# EasyEDA Pro project MyWordEdit.eprj, board PCB1 (continued)
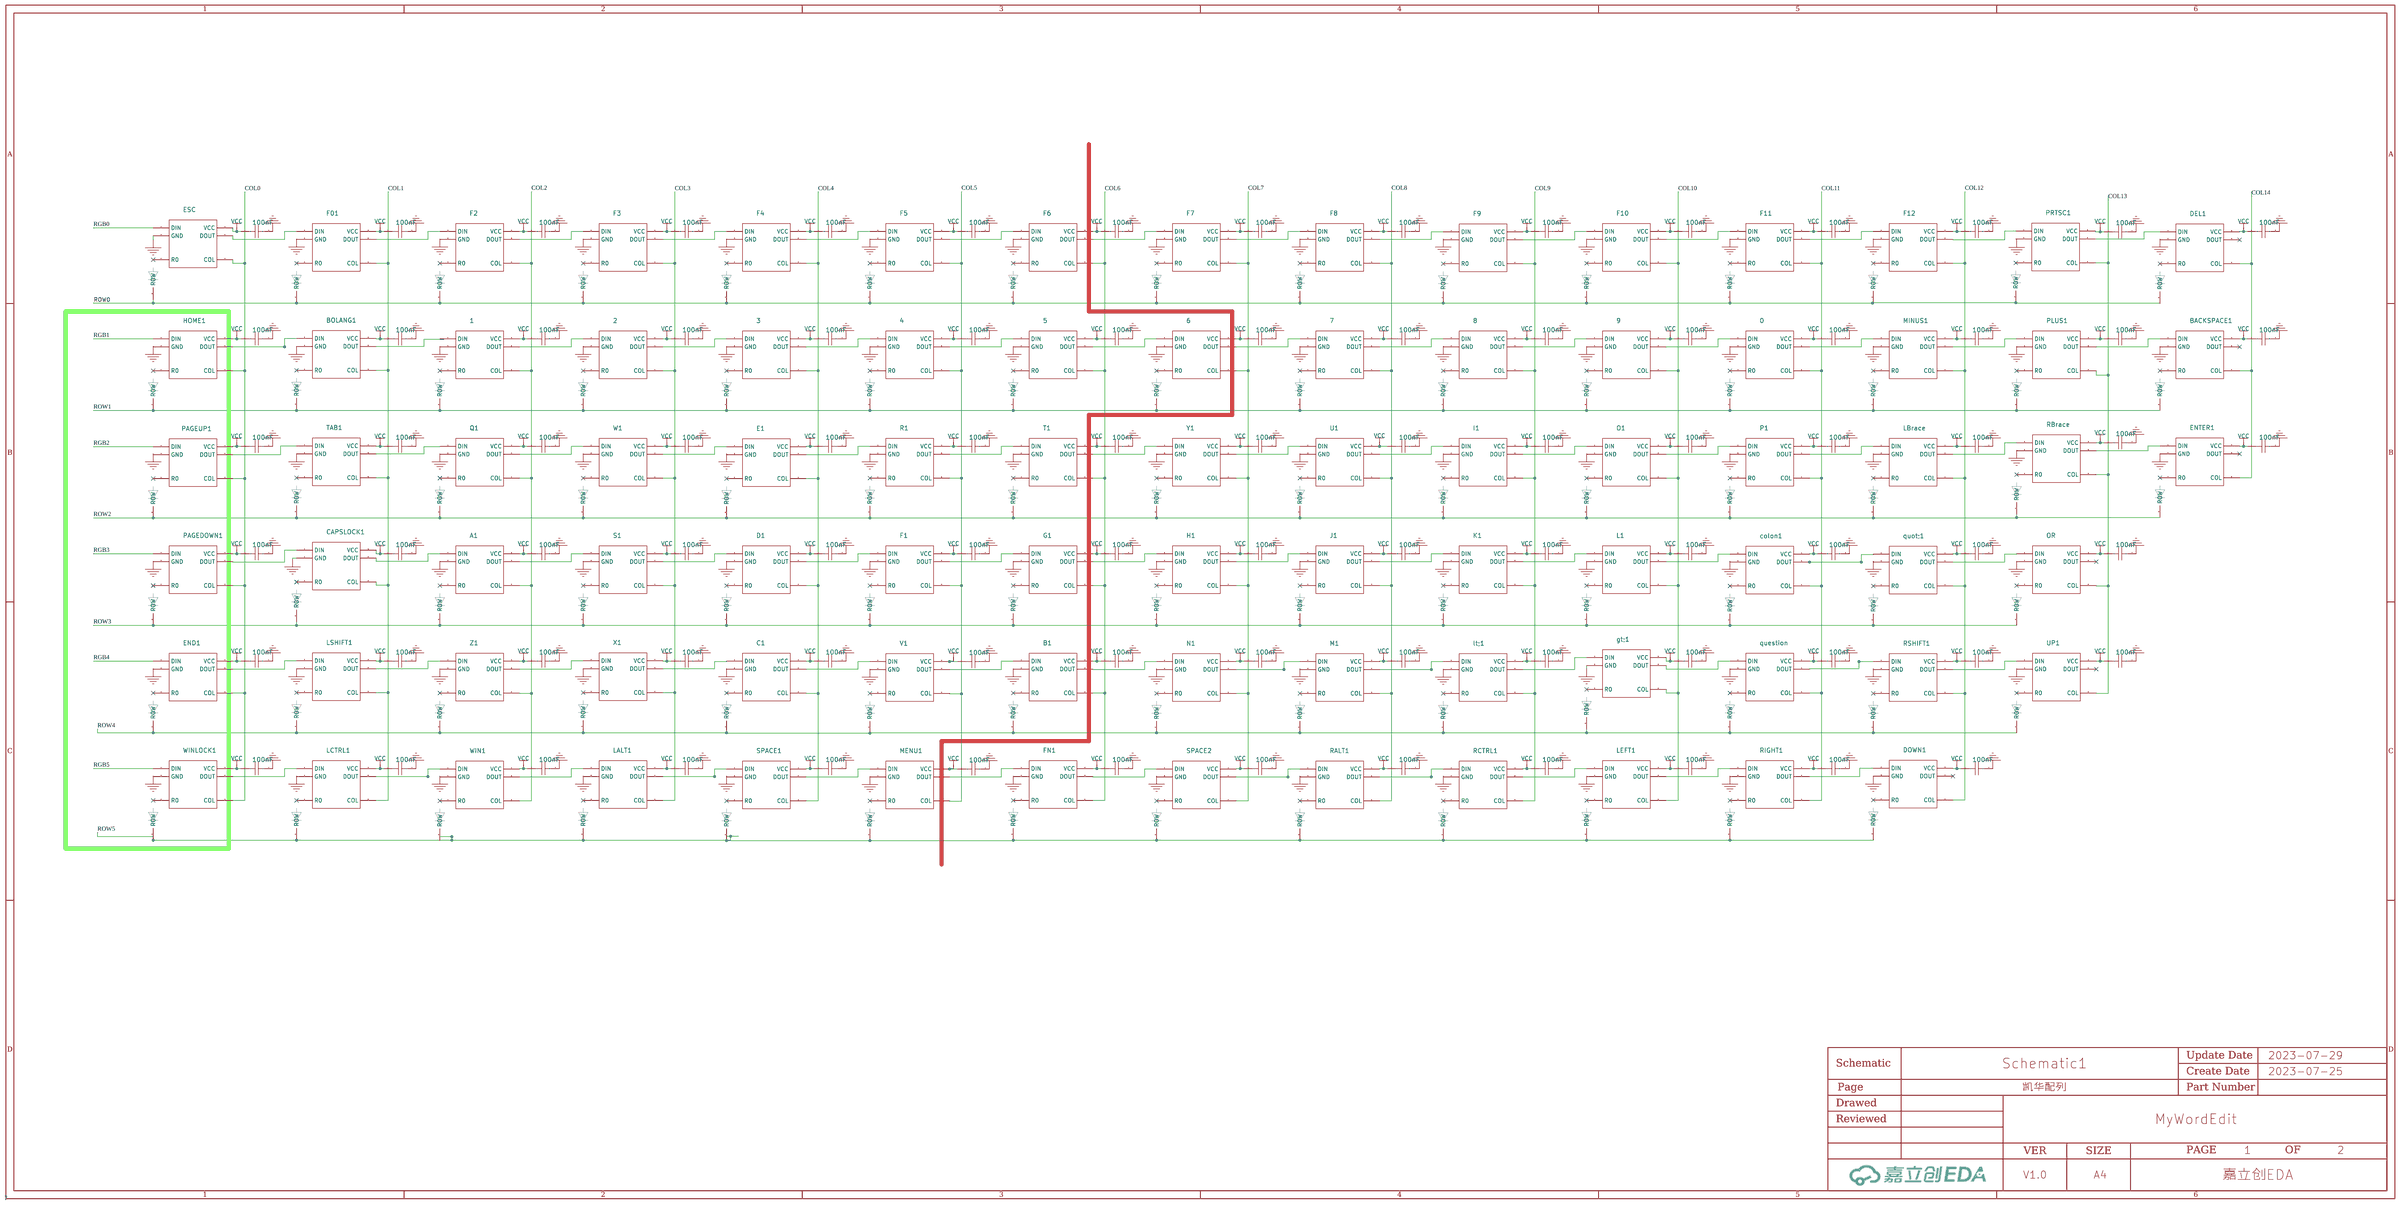
[diagram p0: 凯华配列]
## Routing (per net, layer and track width the routed paths; a pad name or vN(x,y) marks a point on that pad's centre or on a via; arc(x,y) is an arc through that point) (continued)
  Bottom Layer w0.254: ESC.DIN 45.35,122.67 v1(45.47,122.55) ; v1(160.02,45.08) 160.96,44.14 U6.26 ; v1(45.85,120.78) v1(45.85,119)
RGB1: length 232.4
  Top Layer w0.254: v1(160.27,40.77) 160.27,42.42 159.44,43.26 127.69,43.26 125.71,45.24 106.66,45.24 105.26,46.63 90.28,46.63 88.73,48.18 73.11,48.18 71.58,49.71 54.95,49.71 52.43,52.22 33.51,52.22 28.75,56.98 28.75,63.17 27.29,64.63 10.17,64.63 9.04,65.76 9.04,110.38 15.88,117.22 v1(22.73,117.22)
  Bottom Layer w0.254: U6.27 160.46,40.95 v1(160.27,40.77) ; v1(22.73,117.22) 23.2,116.76 HOME1.DIN
RGB2: length 226.6
  Top Layer w0.254: v1(147.45,51.94) 147.45,51.69 146.3,50.55 146.3,49.91 v1(144.53,48.13) ; v1(154.05,54.86) 153.59,55.32 151.71,55.32 v1(151.64,55.24) ; v1(18.54,99.82) v1(20.96,97.41) ; v1(156.85,55.24) 158.37,55.24 v1(160.27,53.34) ; v1(144.4,42.67) 144.17,42.9 127.54,42.9 125.56,44.88 106.5,44.88 105.11,46.28 90.13,46.28 88.58,47.83 72.96,47.83 71.44,49.35 54.79,49.35 52.27,51.87 33.37,51.87 28.4,56.83 28.4,63.02 27.14,64.28 10.03,64.28 8.26,66.05 v1(8.26,98.81)
  Bottom Layer w0.254: v1(8.26,98.81) 9.27,99.82 v1(18.54,99.82) ; v1(160.27,53.34) 160.56,53.34 160.96,53.74 U6.55 ; v1(20.96,97.41) 21.55,96.82 PAGEUP1.DIN ; v1(144.4,42.67) 144.91,43.18 144.91,47.75 v1(144.53,48.13) ; v1(147.45,51.94) 147.45,52.9 149.79,55.24 v1(151.64,55.24) ; v1(156.85,55.24) 154.43,55.24 v1(154.05,54.86)
RGB3: length 166.7
  Top Layer w0.254: v1(22.1,76.71) 33.02,76.71 37.47,72.26 59.18,72.26 61.34,70.1 78.61,70.1 80.14,68.58 97.54,68.58 99.45,66.67 116.69,66.67 118.08,65.28 135.13,65.28 136.91,63.5 v1(149.48,63.5) ; v1(159.13,61.34) 159.13,62.99 v1(158.62,63.5) ; v1(167.64,55.88) 167.01,55.24 163.51,55.24 162.88,54.61 162.05,54.61 161.29,53.85 v1(161.29,53.21) ; v1(160.78,61.34) 162.31,61.34 165.35,58.29 v1(165.35,58.17)
  Bottom Layer w0.254: v1(160.78,61.34) v1(159.13,61.34) ; v1(158.62,63.5) v1(149.48,63.5) ; v1(22.1,76.71) 21.98,76.82 PAGEDOWN1.DIN ; v1(161.29,53.21) 161.29,53.55 161.46,53.72 U6.56 ; v1(167.64,55.88) v1(165.35,58.17)
RGB4: length 161.3
  Top Layer w0.254: v1(162.94,50.8) 162.94,52.45 v1(162.05,53.34) ; v1(156.34,44.32) 156.34,48.07 158.56,50.29 v1(160.53,50.29) ; v1(20.7,57.53) 27.2,57.53 33.22,51.51 52.12,51.51 54.64,49 71.27,49 72.8,47.47 88.42,47.47 89.97,45.92 104.95,45.92 106.35,44.52 125.4,44.52 127.38,42.54 143.7,42.54 144.21,42.04 144.59,42.04 145.23,42.67 v1(154.05,42.67)
  Bottom Layer w0.254: v1(154.05,42.67) 154.69,42.67 v1(156.34,44.32) ; v1(162.94,50.8) 162.43,50.29 v1(160.53,50.29) ; v1(20.7,57.53) 18.62,57.53 END1.DIN ; v1(162.05,53.34) 161.96,53.43 U6.57
RGB5: length 168.9
  Top Layer w0.254: v1(155.32,42.42) 154.81,41.91 150.88,41.91 v1(145.03,36.07) ; v1(157.23,44.32) 157.23,47.88 v1(159,49.66) ; v1(19.18,39.12) 35.91,39.12 41.5,33.53 69.69,33.53 72.02,31.21 89.29,31.21 90.94,29.56 108.34,29.56 109.99,27.91 127.26,27.91 128.91,26.25 130.78,26.25 132.46,27.94 136.94,27.94 141.48,32.48 141.48,32.51 v1(143.38,34.42)
  Bottom Layer w0.254: v1(145.03,36.07) v1(143.38,34.42) ; WINLOCK1.DIN 16.73,39.12 v1(19.18,39.12) ; U6.61 163.96,53.59 v1(164.21,53.34) 164.21,51.24 162.62,49.66 v1(159,49.66) ; v1(155.32,42.42) v1(157.23,44.32)
ROW0: length 436.7
  Top Layer w0.254: v1(162.31,67.72) 162.31,66.17 v1(168.53,59.94) ; v1(167.13,92.07) 167.13,104.9 v1(169.67,107.44) ; v1(167.13,89.66) 167.13,80.01 162.31,75.18 v1(162.31,71.12) ; v1(170.18,45.21) 170.82,45.85 170.82,52.58 174.37,56.13 v1(174.37,56.9)
  Bottom Layer w0.254: F6.ROW 145.68,111.01 147.58,112.91 ; v1(167.13,89.66) v1(167.13,92.07) ; F2.ROW 69.86,117.61 70.75,118.51 ; 52.86,120.55 54.99,122.68 66.58,122.68 70.75,118.51 ; 52.86,120.55 49.42,123.98 48.99,123.98 48.29,124.69 37.95,124.69 37.22,123.95 34.8,123.95 31.89,121.04 ESC.ROW ; 52.86,120.55 50.81,118.5 F01.ROW ; 128.86,114 126.76,111.9 F5.ROW ; 128.86,114 125,117.86 111.38,117.86 109.1,115.57 ; 128.86,114 130.81,115.95 144.54,115.95 147.58,112.91 ; 265.73,120.95 F12.ROW ; 265.73,120.95 264.89,121.79 250.19,121.79 249.56,121.16 249.56,120.4 249.3,120.14 ; 265.73,120.95 268.5,123.72 287.5,123.72 287.66,123.57 ; 147.58,112.91 149.23,114.55 158.56,114.55 162.7,110.41 170.3,110.41 170.86,109.85 ; v1(168.53,59.94) 168.59,59.94 171.64,56.9 v1(174.37,56.9) ; 189.79,112.32 F8.ROW ; 189.79,112.32 187.17,114.93 174.12,114.93 170.86,111.68 170.86,109.85 ; 189.79,112.32 189.91,112.32 192.66,115.06 194.31,115.06 194.95,115.7 196.72,115.7 196.98,115.95 199.01,115.95 199.77,116.71 205.36,116.71 205.61,116.46 207.69,116.46 209.32,114.83 ; 246.81,114.71 246.81,117.65 249.3,120.14 ; 209.32,114.83 208.84,114.35 F9.ROW ; 209.32,114.83 212.47,117.98 227.57,117.98 228.4,117.15 ; 170.86,109.85 170.86,108.11 170.34,108.11 v1(169.67,107.44) ; 70.75,118.51 73.15,120.9 85.28,120.9 89.63,116.55 ; F10.ROW 227.76,116.51 228.4,117.15 ; F3.ROW 88.78,115.71 89.63,116.55 ; 89.63,116.55 92.46,119.38 105.29,119.38 109.1,115.57 ; 287.66,123.57 284.78,120.7 PRTSC1.ROW ; 287.66,123.57 287.66,124.14 288.74,125.22 296.04,125.22 301.59,119.66 DEL1.ROW ; 109.1,115.57 107.84,114.31 F4.ROW ; U6.14 168.77,46.14 169.71,45.21 v1(170.18,45.21) ; 228.4,117.15 230.41,119.16 230.41,119.79 230.89,120.27 242.41,120.27 242.48,120.19 249.25,120.19 249.3,120.14 ; v1(162.31,71.12) v1(162.31,67.72)
ROW1: length 440.8
  Top Layer w0.254: v1(166.62,58.8) 161.42,64.01 v1(161.42,66.8) ; v1(169.42,55.88) v1(169.42,44.7) ; v1(171.2,89.03) 169.8,90.42 166.5,90.42 166.12,90.04 166.12,79.5 161.72,75.11 161.72,70.66 v1(161.42,70.36)
  Bottom Layer w0.254: 88.39,97.79 87.13,96.53 3.ROW ; 88.39,97.79 91.19,100.58 105.01,100.58 108.19,97.4 ; 88.39,97.79 84.08,102.11 69.85,102.11 68.71,100.96 68.71,100.25 ; v1(169.42,44.7) 168.48,45.64 U6.15 ; 211.79,95.33 210.49,94.03 210.49,92.36 ; 211.79,95.33 215.14,98.68 229.64,98.68 230.39,97.93 ; 211.79,95.33 209.83,97.28 200.15,97.28 199.64,96.77 196.98,96.77 196.34,96.14 195.33,96.14 194.95,95.76 194.32,95.76 193.21,94.66 192.19,94.66 ; 230.39,97.93 229.41,96.95 0.ROW ; 230.39,97.93 233.05,100.58 248.08,100.58 248.95,99.72 ; 68.71,100.25 68.71,97.55 2.ROW ; 68.71,100.25 64.5,104.45 61.16,104.45 60.71,104.9 54.61,104.9 54.36,104.65 53.85,104.65 52.2,103 52.2,102.54 52.22,102.51 49.16,99.45 1.ROW 49.13,98.81 48.51,98.81 48.01,99.31 48.01,102.49 48.26,102.75 48.26,103.22 45.82,105.66 39.33,105.66 ; 8.ROW 191.57,94.03 192.19,94.66 ; v1(166.62,58.8) 169.42,56.01 v1(169.42,55.88) ; 192.19,94.66 190.83,96.01 176.78,96.01 173.75,92.98 ; HOME1.ROW 12.68,112.14 20.97,112.14 22.5,110.62 34.37,110.62 39.33,105.66 ; BACKSPACE1.ROW 291.67,104.01 272.03,104.01 269.19,101.16 ; 173.75,92.98 172.59,91.82 172.59,89.14 7.ROW 172.48,89.03 v1(171.2,89.03) ; 173.75,92.98 172.12,94.61 155.7,94.61 154.05,96.27 147.96,96.27 147.7,96.01 ; v1(161.42,70.36) v1(161.42,66.8) ; 248.95,99.72 248.46,99.24 MINUS1.ROW ; 248.95,99.72 251.21,101.98 268.37,101.98 269.19,101.16 ; 108.19,97.4 106.06,95.26 4.ROW ; 108.19,97.4 109.44,98.65 112.94,98.65 113.12,98.46 116.36,98.46 116.54,98.65 122.81,98.65 126.09,95.36 ; 126.09,95.36 125.11,94.37 5.ROW ; 126.09,95.36 129.19,98.45 135.36,98.45 137.54,96.27 142.31,96.27 144.08,98.04 144.84,98.04 146.88,96.01 147.7,96.01 ; 39.33,105.66 32.89,105.66 30.1,102.87 30.1,100.62 BOLANG1.ROW ; 147.7,96.01 144.03,92.34 6.ROW ; 269.19,101.16 267.38,99.36 267.38,97.44
ROW2: length 360.2
  Top Layer w0.254: v1(168.78,44.2) 168.78,55.63 v1(168.53,55.88) ; v1(163.32,69.21) 162.43,69.21 160.78,67.56 160.78,63.75 v1(165.61,58.93)
  Bottom Layer w0.254: v1(165.61,58.93) 168.53,56.01 v1(168.53,55.88) ; v1(168.78,44.2) 167.83,45.14 U6.16 ; Y1.ROW 161.44,65.91 153.54,65.91 146.69,72.77 133.46,72.77 T1.ROW 130.85,74.42 114.41,74.42 R1.ROW 111.67,76.2 95.44,76.2 E1.ROW 92.78,77.85 76.44,77.85 W1.ROW 73.83,79.5 57.51,79.5 Q1.ROW 54.4,81.66 33.78,81.66 33.29,81.16 ; Y1.ROW 164.77,70.03 165.86,71.12 183.47,71.12 U1.ROW 183.69,71.17 185.29,72.77 202.39,72.77 202.61,72.55 202.61,72.57 204.47,74.42 221.44,74.42 O1.ROW 221.66,74.85 223.01,76.2 231.14,76.2 231.49,75.85 P1.ROW 240.7,75.85 242.57,77.72 259.54,77.72 259.64,77.63 261.51,79.5 278.34,79.5 RBrace.ROW 279.29,80.01 283.85,80.01 284.99,81.15 300.36,81.15 305.49,76.02 305.49,72.04 ; Y1.ROW 163.35,69.25 v1(163.32,69.21) ; PAGEUP1.ROW 11.03,93.22 26.92,93.22 33.29,86.86 33.29,81.16 ; 33.29,81.16 TAB1.ROW
ROW3: length 324.5
  Top Layer w0.254: v1(172.47,49.4) 172.47,44.45 170.56,42.54 v1(166.24,42.54)
  Bottom Layer w0.254: 34.33,62.16 34.65,62.48 57.19,62.48 A1.ROW 60.56,60.07 77,60.07 S1.ROW 79.74,58.55 95.8,58.55 D1.ROW 98.66,56.9 114.72,56.9 F1.ROW 117.59,55.24 133.77,55.24 G1.ROW 136.65,53.61 136.65,55.63 140.46,59.44 144.27,59.44 147.75,62.92 164.29,62.92 173.67,53.53 173.67,52.58 ; 34.33,62.16 CAPSLOCK1.ROW ; 34.33,62.16 28.58,67.91 28.58,72.39 26.8,74.17 9.38,74.17 PAGEDOWN1.ROW ; 173.67,52.58 189.82,52.58 J1.ROW 190.53,52.35 192.53,54.36 208.74,54.36 K1.ROW 209.58,54.01 211.58,56.01 227.74,56.01 228.01,55.73 ; 173.67,52.58 173.67,51.37 173.01,50.7 171.17,50.7 ; L1.ROW 228.01,55.73 ; 228.01,55.73 228.01,55.8 229.87,57.66 246.41,57.66 246.76,57.31 247.68,57.31 249.68,59.31 265.64,59.31 quot;1.ROW 267.99,60.96 284.69,60.96 OR.ROW ; v1(172.47,49.4) 171.17,50.7 ; 171.17,50.7 171.12,50.7 ; v1(166.24,42.54) 166.11,42.54 U6.17
ROW4: length 337.6
  Top Layer w0.254: v1(162.18,39.12) 162.18,40 v1(162.56,40.39)
  Bottom Layer w0.254: 166.14,38.99 177.67,38.99 182.58,34.08 182.58,32.54 ; 166.14,38.99 162.31,38.99 v1(162.18,39.12) ; 166.14,38.99 165.9,38.75 165.9,35.22 165.56,34.88 164.12,34.88 162.88,33.64 144.03,33.64 143.78,33.39 B1.ROW 143.1,33.18 141.35,34.92 134.02,34.92 133.64,35.31 125.33,35.31 V1.ROW 122.72,36.96 106.41,36.96 C1.ROW 103.8,38.61 91.57,38.61 91.44,38.48 87.23,38.48 X1.ROW 84.75,40.26 68.44,40.26 Z1.ROW 64.68,43.05 37.7,43.05 LSHIFT1.ROW 24.42,55.12 7.6,55.12 END1.ROW ; 182.58,32.54 183.04,32.54 185.02,34.52 200.96,34.52 201.22,34.27 ; 182.58,32.54 N1.ROW ; U6.20 163.96,41.79 v1(162.56,40.39) ; M1.ROW 201.22,34.27 ; 201.22,34.27 201.22,34.34 203.07,36.19 219.92,36.19 lt;1.ROW 220.27,35.86 222.12,37.72 238.97,37.72 239.19,37.5 241.19,39.5 257.76,39.5 question.ROW 259.99,41.02 283.86,41.02 RSHIFT1.ROW 286.28,43.43 303.02,43.43 303.31,43.72 UP1.ROW
ROW5: length 381.7
  Top Layer w0.254: v1(173.23,14.48) v1(173.23,16.89) ; v1(166.98,38.35) v1(164.88,38.35) ; v1(173.23,18.54) 173.23,37.47 v1(172.47,38.23) ; v1(161.54,38.35) v1(161.54,40.39)
  Bottom Layer w0.254: U6.21 163.46,42.3 v1(161.54,40.39) ; v1(173.23,14.48) 174.42,13.29 FN1.ROW ; v1(172.47,38.23) 172.34,38.35 v1(166.98,38.35) ; v1(164.88,38.35) v1(161.54,38.35) ; 293.04,23.29 294.77,25.02 311.74,25.02 311.96,24.8 ; 293.04,23.29 RIGHT1.ROW ; 293.04,23.29 292.83,23.5 277.5,23.5 275.49,21.49 LEFT1.ROW 273.89,21.72 258.06,21.72 256.19,19.84 RCTRL1.ROW 254.84,20.07 238.02,20.07 236.14,18.19 219.49,18.19 218.57,17.27 207.26,17.27 205.39,15.4 SPACE2.ROW 185.83,15.4 185.04,14.6 176.53,14.6 174.66,12.73 FN1.ROW ; FN1.ROW 173.1,11.41 173.1,6.35 171.7,4.95 164.64,4.95 154.62,14.97 137.89,14.97 MENU1.ROW 134.17,17.77 107.03,17.77 SPACE1.ROW 103.16,20.7 74.02,20.7 LALT1.ROW 70.65,22.86 50.28,22.86 WIN1.ROW 47.16,24.76 26.4,24.76 LCTRL1.ROW 25.92,32.63 22.35,36.19 5.95,36.19 WINLOCK1.ROW ; v1(173.23,18.54) v1(173.23,16.89)
SWCLK: length 19
  Top Layer w0.254: SWD.3 157.97,71.12 159.39,69.7 159.39,68.45 158.04,67.11 158.04,61.61 159.13,60.51 v1(159.13,57.53)
  Bottom Layer w0.254: U6.49 157.96,56.36 v1(159.13,57.53)
SWDIO: length 31.5
  Top Layer w0.254: v1(156.72,54.48) 156.46,54.48 154.94,56.01 v1(154.94,56.26) ; 157.61,73.66 156.85,73.66 156.21,73.02 156.21,68.07 156.85,67.44 156.85,61.72 158.5,60.07 158.5,58.67 157.35,57.53 v1(153.8,57.53)
  Bottom Layer w0.254: v1(153.8,57.53) 154.94,56.39 v1(154.94,56.26) ; U6.46 155.22,51.64 154.94,51.92 v1(154.94,53.59) 155.83,54.48 v1(156.72,54.48)
SYSPWREN: length 189.7
  Top Layer w0.254: v1(72.01,4.32) 35.43,4.32 31.75,8 v1(31.75,9.14)
  Bottom Layer w0.254: 4.32,117.86 2.92,116.46 2.92,113.15 3.18,112.9 3.18,25.53 19.56,9.14 v1(31.75,9.14) 43.05,9.14 44.32,7.87 44.32,5.59 44.78,5.13 U4.3 ; U3.3 72.6,3.73 v1(72.01,4.32)
U1_RX: length 83.4
  Top Layer w0.254: v1(163.07,98.42) 162.18,97.54 v1(162.18,91.95) ; v1(153.8,50.67) 153.54,50.67 v1(151.77,52.45) ; v1(151.89,70.1) 151.89,68.45 151.26,67.82 151.26,60.71 149.61,59.05 v1(149.61,58.17) ; v1(151.89,73.02) 153.09,74.22 153.09,75.54 155.85,78.31 157.82,78.31 162.18,82.67 v1(162.18,89.41) ; v1(169.67,114.68) 166.75,111.76 166.75,109.79 165.16,108.2 v1(163.7,108.2) ; v1(149.61,56.9) 150.21,56.29 150.21,52.1 v1(150.24,52.07)
  Bottom Layer w0.254: v1(163.07,98.42) 163.32,98.68 163.32,107.82 v1(163.7,108.2) ; v1(150.24,52.07) 151.38,52.07 v1(151.77,52.45) ; v1(153.8,50.67) 154.33,50.14 U6.43 ; v1(162.18,91.95) v1(162.18,89.41) ; v1(151.89,73.02) v1(151.89,70.1) ; v1(169.67,114.68) 171.34,116.35 BTK-05.1 ; v1(149.61,58.17) v1(149.61,56.9)
U1_TX: length 83
  Top Layer w0.254: v1(164.59,98.55) 164.72,98.42 v1(164.72,92.07) ; v1(153.92,49.66) 153.48,49.66 150.88,52.26 v1(150.88,56.26) ; v1(164.59,109.47) 165.1,109.98 v1(165.1,115.44) ; v1(162.94,83.69) 162.94,82.93 157.97,77.95 156,77.95 153.44,75.4 153.44,73.05 v1(152.91,72.52) ; v1(150.88,57.91) 150.88,58.42 153.16,60.71 153.16,66.29 152.91,66.55 v1(152.91,69.21)
  Bottom Layer w0.254: v1(162.94,83.69) 164.72,85.47 v1(164.72,92.07) ; v1(152.91,72.52) v1(152.91,69.21) ; v1(153.92,49.66) 153.94,49.64 U6.42 ; v1(164.59,109.47) v1(164.59,98.55) ; BTK-05.2 169.84,116.22 169.57,115.95 165.61,115.95 v1(165.1,115.44) ; v1(150.88,57.91) v1(150.88,56.26)
USBDM: length 215.9
  Top Layer w0.254: v1(48.01,119) 48.01,116.55 44.96,113.5 v1(44.96,102.23) ; v1(146.94,57.4) 146.94,57.28 148.97,55.24 148.97,53.85 v1(149.48,53.34) ; v1(47.75,91.95) 44.96,94.74 v1(44.96,99.82) ; v1(47.24,131.57) 34.16,131.57 v1(31.37,128.78) ; v1(52.07,130.3) v1(48.51,130.3) v1(45.85,130.3) ; v1(53.34,80.39) 53.34,83.5 51.75,85.09 51.31,85.09 v1(50.8,85.6) ; v1(32.51,127.76) 32.97,127.3 42.49,127.3 48.01,121.79 v1(48.01,120.9) ; v1(53.98,71.25) 59.19,71.25 61.05,69.39 78.32,69.39 79.84,67.87 97.25,67.87 99.15,65.96 116.39,65.96 117.79,64.57 134.83,64.57 136.66,62.74 142.87,62.74 v1(146.18,59.44) ; v1(153.42,53.34) v1(151.77,53.34)
  Bottom Layer w0.254: v1(32.51,127.76) 32.39,127.76 v1(31.37,128.78) ; v1(47.75,91.95) 47.75,91.56 50.27,89.05 50.27,86.13 v1(50.8,85.6) ; v1(47.24,131.57) v1(48.51,130.3) ; v1(146.18,59.44) 146.94,58.67 v1(146.94,57.4) ; v1(53.98,71.25) 53.34,71.88 v1(53.34,80.39) ; R12.1 52.07,129.64 v1(52.07,130.3) ; v1(153.42,53.34) 153.42,52.07 154.84,50.64 U6.44 ; v1(48.01,119) v1(48.01,120.9) ; v1(45.85,130.3) 45.85,129.34 R21.1 ; v1(44.96,102.23) v1(44.96,99.82) ; v1(149.48,53.34) v1(151.77,53.34)
USBDP: length 225.1
  Top Layer w0.254: v1(147.57,58.93) 143.36,63.14 136.76,63.14 134.98,64.92 117.93,64.92 116.54,66.32 99.3,66.32 97.39,68.22 79.99,68.22 78.47,69.75 61.19,69.75 59.04,71.91 37.32,71.91 33.28,75.95 v1(30.1,75.95) ; v1(148.21,57.4) 148.27,57.4 149.61,56.07 v1(149.61,54.23) ; v1(54.23,130.43) 53.77,130.89 37.67,130.89 v1(37.08,130.3) 33.84,130.3 29.85,126.3 29.85,120.27 v1(29.72,120.14) ; v1(29.46,78.36) v1(29.46,85.72) ; v1(30.23,88.26) 31.75,89.79 31.75,95.68 34.49,98.42 34.49,99.87 32.77,101.6 32.77,103.89 27.18,109.47 v1(27.18,111.38) ; v1(151.77,54.36) 153.67,54.36 v1(154.05,53.97)
  Bottom Layer w0.254: R20.1 36.79,130.01 v1(37.08,130.3) ; v1(149.61,54.23) 151.64,54.23 v1(151.77,54.36) ; v1(30.23,88.26) 29.46,87.5 v1(29.46,85.72) ; v1(148.21,57.4) 148.08,57.4 147.57,57.91 v1(147.57,58.93) ; R11.1 54.45,130.21 v1(54.23,130.43) ; U6.45 154.98,51.14 154.05,52.07 v1(154.05,53.97) ; v1(27.18,111.38) 27.18,114.18 28.96,115.96 28.96,119.38 v1(29.72,120.14) ; v1(29.46,78.36) 29.46,76.58 v1(30.1,75.95)
WAKEUP: length 105.7
  Top Layer w0.254: v1(159.89,59.69) 160.02,59.82 v1(160.02,66.8) ; v1(162.18,44.58) 162.18,50.61 159.19,53.59 156.65,53.59 153.98,56.26 v1(153.04,56.26) ; v1(171.32,128.52) 171.32,114.93 v1(170.43,114.05) 167.39,111 v1(167.39,109.6) ; v1(153.04,57.78) 153.04,58.8 153.67,59.44 v1(157.87,59.44) ; v1(167.89,77.98) v1(166.37,76.45) ; v1(166.37,98.55) 166.37,92.33 v1(166.24,92.2)
  Bottom Layer w0.254: v1(166.24,92.2) 166.24,79.63 v1(167.89,77.98) ; v1(159.89,59.69) 159.64,59.44 v1(157.87,59.44) ; v1(171.32,128.52) 171.34,128.54 BTK-05.34 ; U6.23 162.46,44.07 162.18,44.35 v1(162.18,44.58) ; v1(160.02,66.8) 160.02,70.1 v1(166.37,76.45) ; v1(166.37,98.55) 166.19,98.73 166.19,108.41 v1(167.39,109.6) ; v1(153.04,56.26) v1(153.04,57.78)
XT_IN: length 38.4
  Top Layer w0.254: v1(165.35,50.67) 164.97,50.29 164.97,48.71 163.63,47.36 163.63,45.54 165.47,43.7 v1(167.18,43.7) ; v1(165.99,40.39) 168.02,38.35 v1(168.02,35.43)
  Bottom Layer w0.254: v1(168.02,35.43) 168.02,34.04 168.22,33.84 R18.2 169.16,33.02 170.82,31.37 C17.1 170.82,27.53 173.23,25.12 X2.2 ; v1(165.35,50.67) 166.35,50.67 166.38,50.64 U6.5 ; v1(165.99,40.39) 167.18,41.58 v1(167.18,43.7)
XT_OUT: length 37.4
  Top Layer w0.254: v1(164.21,47.12) 164.21,45.46 165.39,44.29 167.55,44.29 v1(168.15,43.69) ; v1(170.31,37.21) 170.05,37.21 v1(166.88,40.39)
  Bottom Layer w0.254: U6.6 165.84,50.14 165.3,49.61 165.3,48.08 164.34,47.12 v1(164.21,47.12) ; C18.1 166.25,36.71 166.55,37.01 167.56,37.01 168.04,37.48 170.03,37.48 v1(170.31,37.21) 170.82,36.7 R18.1 176.3,33.84 X2.1 ; v1(168.15,43.69) 168.15,41.66 v1(166.88,40.39)
$2N29006: length 41.2
  Top Layer w0.254: v1(47.88,46.86) 46.86,47.88 29.08,47.88 21.84,55.12 13.34,55.12 v1(12.7,55.75)
  Bottom Layer w0.254: v1(12.7,55.75) 12.48,55.97 END1.DOUT ; LSHIFT1.DIN 48.22,46.52 v1(47.88,46.86)
$2N29026: length 29.7
  Top Layer w0.254: v1(256.79,63.37) 256.16,64.01 250.57,64.01 247.65,61.09 241.43,61.09 240.54,61.98 233.81,61.98 233.17,61.34 v1(233.17,59.44)
  Bottom Layer w0.254: v1(233.17,59.44) 233.17,58.91 232.93,58.67 ; v1(256.79,63.37) 257.45,62.72 colon1.DIN
$2N29033: length 35.8
  Top Layer w0.254: v1(240.16,60.45) 240.16,58.04 239.65,57.53 231.52,57.53 230.89,58.17 224.03,58.17 221.87,56.01 212.85,56.01 v1(212.22,56.64)
  Bottom Layer w0.254: L1.DIN 239.81,60.8 v1(240.16,60.45) ; v1(212.22,56.64) 212.6,57.02 212.73,57.02 212.73,57.01 K1.DOUT
$2N29040: length 29.6
  Top Layer w0.254: v1(195.07,56.13) 195.07,57.91 196.09,58.93 203.58,58.93 205.99,61.34 217.81,61.34 v1(219.08,60.07)
  Bottom Layer w0.254: K1.DIN 219.48,59.67 v1(219.08,60.07) ; J1.DOUT 195.07,55.48 v1(195.07,56.13)
$2N29047: length 35.1
  Top Layer w0.254: v1(174.37,53.47) 175.26,52.58 183.64,52.58 186.31,55.24 189.23,55.24 190.12,54.36 200.91,54.36 202.18,55.63 v1(202.18,56.64)
  Bottom Layer w0.254: v1(174.37,53.47) 174.62,53.71 176.03,53.71 ; J1.DIN 201.33,57.5 v1(202.18,56.64)
$2N29054: length 45.6
  Top Layer w0.254: v1(171.07,58.67) 171.01,58.67 169.28,56.95 150.7,56.95 150.11,57.53 149.04,57.53 148.4,58.17 142.37,58.17 141.61,57.4 v1(141.61,55.88) ; v1(173.48,58.67) 179.71,58.67 v1(181.48,56.9)
  Bottom Layer w0.254: v1(141.61,55.88) 141.61,55.31 G1.DOUT ; v1(173.48,58.67) v1(171.07,58.67) ; v1(181.48,56.9) 181.5,56.87 H1.DIN
$2N29061: length 29.2
  Top Layer w0.254: v1(122.68,55.88) 123.44,55.12 130.68,55.12 132.72,53.09 132.72,52.96 137.41,52.96 138.05,53.59 146.3,53.59 146.81,54.1 v1(146.81,55.5)
  Bottom Layer w0.254: v1(146.81,55.5) 147.15,55.84 G1.DIN ; 122.34,56.75 122.68,56.41 v1(122.68,55.88)
$2N29068: length 30.7
  Top Layer w0.254: v1(103.89,59.05) 103.89,60.45 104.65,61.21 109.98,61.21 112.4,58.8 114.81,58.8 115.95,57.66 118.36,57.66 120.65,59.94 127.13,59.94 v1(128.14,58.93)
  Bottom Layer w0.254: D1.DOUT 103.42,58.58 v1(103.89,59.05) ; v1(128.14,58.93) 128.14,57.94 F1.DIN
$2N29075: length 31.7
  Top Layer w0.254: v1(110.74,58.67) 110.74,57.15 110.36,56.77 94.49,56.77 92.85,58.41 85.35,58.41 v1(84.58,59.18)
  Bottom Layer w0.254: D1.DIN 109.87,59.55 v1(110.74,58.67) ; v1(84.58,59.18) 84.58,59.96 S1.DOUT
$2N29082: length 29.9
  Top Layer w0.254: v1(65.91,62.36) 65.91,63.75 66.55,64.39 72.14,64.39 74.17,62.36 76.58,62.36 77.34,61.59 81.15,61.59 82.8,63.25 88.77,63.25 v1(89.92,62.1)
  Bottom Layer w0.254: S1.DIN 90.25,61.76 v1(89.92,62.1) ; v1(65.91,62.36) 65.91,62.17 65.44,61.7
$2N29092: length 36.6
  Top Layer w0.254: v1(262.64,80.26) 263.27,79.63 270.51,79.63 273.43,82.55 276.86,82.55 278.13,81.28 289.56,81.28 291.08,82.8 v1(291.08,83.95)
  Bottom Layer w0.254: v1(262.64,80.26) 264.18,80.26 LBrace.DOUT ; v1(291.08,83.95) 290.61,84.42 RBrace.DIN
$2N29099: length 29.6
  Top Layer w0.254: v1(245.62,79.63) 245.62,81.79 246.51,82.68 255.65,82.68 257.68,84.71 268.35,84.71 v1(269.37,83.69)
  Bottom Layer w0.254: v1(245.62,79.63) 245.5,79.51 P1.DOUT ; v1(269.37,83.69) 270.02,83.04 LBrace.DIN
$2N29109: length 40
  Top Layer w0.254: v1(304.67,106.3) 299.72,106.3 297.82,108.2 278.13,108.2 273.43,103.5 272.92,103.5 272.29,102.87 v1(272.29,101.22)
  Bottom Layer w0.254: PLUS1.DOUT 272.3,101.21 v1(272.29,101.22) ; v1(304.67,106.3) 305.18,106.3 306.22,105.26 BACKSPACE1.DIN
$2N29116: length 35
  Top Layer w0.254: v1(252.6,81.15) 252.6,78.36 252.1,77.85 235.84,77.85 234.06,76.07 225.93,76.07 v1(225.04,76.96)
  Bottom Layer w0.254: v1(225.04,76.96) 225.29,77.21 O1.DOUT ; P1.DIN 251.13,81.15 v1(252.6,81.15)
$2N29123: length 30.5
  Top Layer w0.254: v1(231.39,80.26) 230.63,81.03 226.06,81.03 223.39,78.36 219.96,78.36 218.82,79.5 208.28,79.5 207.52,78.74 v1(207.52,76.33)
  Bottom Layer w0.254: v1(231.39,80.26) 232.05,79.61 O1.DIN ; v1(207.52,76.33) 207.53,76.32 207.53,75.56
$2N29130: length 36
  Top Layer w0.254: v1(214.63,76.96) 214.63,75.31 213.87,74.55 204.6,74.55 200.91,70.87 199.14,70.87 197.23,72.77 187.96,72.77 v1(186.94,73.79)
  Bottom Layer w0.254: U1.DOUT 188.49,73.79 v1(186.94,73.79) ; v1(214.63,76.96) 213.9,77.69 I1.DIN
$2N29137: length 29.5
  Top Layer w0.254: v1(193.68,76.83) 193.24,77.27 188.14,77.27 186.18,75.31 180.34,75.31 179.45,76.2 170.94,76.2 169.8,75.06 v1(169.8,73.02)
  Bottom Layer w0.254: Y1.DOUT 169.8,72.37 v1(169.8,73.02) ; v1(193.68,76.83) 194.08,76.43 U1.DIN
$2N29144: length 49
  Top Layer w0.254: v1(138.68,73.41) 139.19,72.9 150.37,72.9 v1(154.35,68.92) 154.35,68.41 v1(155.96,66.8) ; v1(159,66.8) v1(160.7,68.5) 163.32,71.12 176.15,71.12 177.29,72.26 v1(177.29,73.79)
  Bottom Layer w0.254: Y1.DIN 176.69,74.39 v1(177.29,73.79) ; v1(155.96,66.8) v1(159,66.8) ; v1(138.68,73.41) 138.34,73.75 T1.DOUT
$2N29151: length 30.3
  Top Layer w0.254: v1(143.76,76.45) 143.13,77.09 136.4,77.09 135.51,76.2 128.12,76.2 124.69,79.63 120.65,79.63 119.38,78.36 v1(119.38,76.83)
  Bottom Layer w0.254: T1.DIN 144.1,76.12 v1(143.76,76.45) ; 119.29,76.05 119.38,76.14 v1(119.38,76.83)
$2N29158: length 31.7
  Top Layer w0.254: v1(126.62,76.58) 126.62,75.06 125.97,74.41 110.5,74.41 108.71,76.2 101.22,76.2 v1(100.58,76.83)
  Bottom Layer w0.254: v1(126.62,76.58) 126,77.21 R1.DIN ; v1(100.58,76.83) 100.58,77.52 E1.DOUT
$2N29165: length 29.1
  Top Layer w0.254: v1(105.66,79.88) 104.78,80.77 98.93,80.77 98.3,80.14 93.47,80.14 91.31,82.3 82.55,82.3 81.66,81.41 v1(81.66,80.26)
  Bottom Layer w0.254: E1.DIN 106.06,79.49 v1(105.66,79.88) ; W1.DOUT 81.66,79.82 v1(81.66,80.26)
$2N29172: length 32.3
  Top Layer w0.254: v1(62.48,80.14) 62.99,79.63 70.61,79.63 73.41,76.83 75.95,76.83 76.96,77.85 88.01,77.85 88.52,78.36 v1(88.52,79.76)
  Bottom Layer w0.254: 62.4,81.13 62.4,80.23 v1(62.48,80.14) ; W1.DIN 87.64,80.63 v1(88.52,79.76)
$2N29189: length 35.2
  Top Layer w0.254: v1(279.53,101.98) 279.53,100.08 278.77,99.31 272.42,99.31 271.53,98.42 266.32,98.42 265.43,97.54 252.48,97.54 v1(251.59,98.42)
  Bottom Layer w0.254: v1(279.53,101.98) 278.92,102.58 PLUS1.DIN ; MINUS1.DOUT 253.13,98.42 v1(251.59,98.42)
$2N29196: length 35.7
  Top Layer w0.254: v1(232.66,96.77) 233.55,95.88 239.27,95.88 241.68,98.3 245.17,98.3 249.95,103.07 258.88,103.07 v1(260.6,101.35)
  Bottom Layer w0.254: MINUS1.DIN 260.06,100.81 v1(260.6,101.35) ; 0.DOUT 234.08,96.77 v1(232.66,96.77)
$2N29203: length 30.6
  Top Layer w0.254: v1(239.27,99.95) 236.6,102.62 220.09,102.62 215.27,97.79 215.27,96.31 v1(215.4,96.17)
  Bottom Layer w0.254: 9.DOUT v1(215.4,96.17) ; v1(239.27,99.95) 239.8,99.42 0.DIN
$2N29210: length 35.8
  Top Layer w0.254: v1(194.69,93.6) 195.58,92.71 208.28,92.71 209.17,93.6 215.9,93.6 216.66,94.36 221.62,94.36 223.27,96.01 v1(223.27,96.77)
  Bottom Layer w0.254: 8.DOUT 194.81,93.72 v1(194.69,93.6) ; 9.DIN 222.89,97.5 223.27,97.12 v1(223.27,96.77)
$2N29217: length 31.5
  Top Layer w0.254: v1(201.42,96.65) 198.37,99.69 197.23,99.69 196.34,100.58 186.06,100.58 180.72,95.25 178.31,95.25 177.55,94.49 v1(177.55,92.84)
  Bottom Layer w0.254: v1(177.55,92.84) 177.43,92.72 7.DOUT ; v1(201.42,96.65) 201.95,96.12 8.DIN
$2N29224: length 40.7
  Top Layer w0.254: v1(149.35,91.69) 149.86,91.19 150.88,91.19 151.13,90.93 183.77,90.93 184.53,91.69 v1(184.53,93.98)
  Bottom Layer w0.254: 7.DIN 184.31,94.2 v1(184.53,93.98) ; 6.DOUT 149.39,91.73 v1(149.35,91.69)
$2N29231: length 31.8
  Top Layer w0.254: v1(154.69,94.74) 151.13,98.3 147.83,98.3 145.54,100.58 134.62,100.58 130.43,96.39 v1(130.43,95)
  Bottom Layer w0.254: v1(154.69,94.74) 155.15,94.28 6.DIN ; 130.47,94.21 130.47,94.96 v1(130.43,95)
